# EasyEDA Pro project Arduino UNO DIY.eprj, board PCB3B
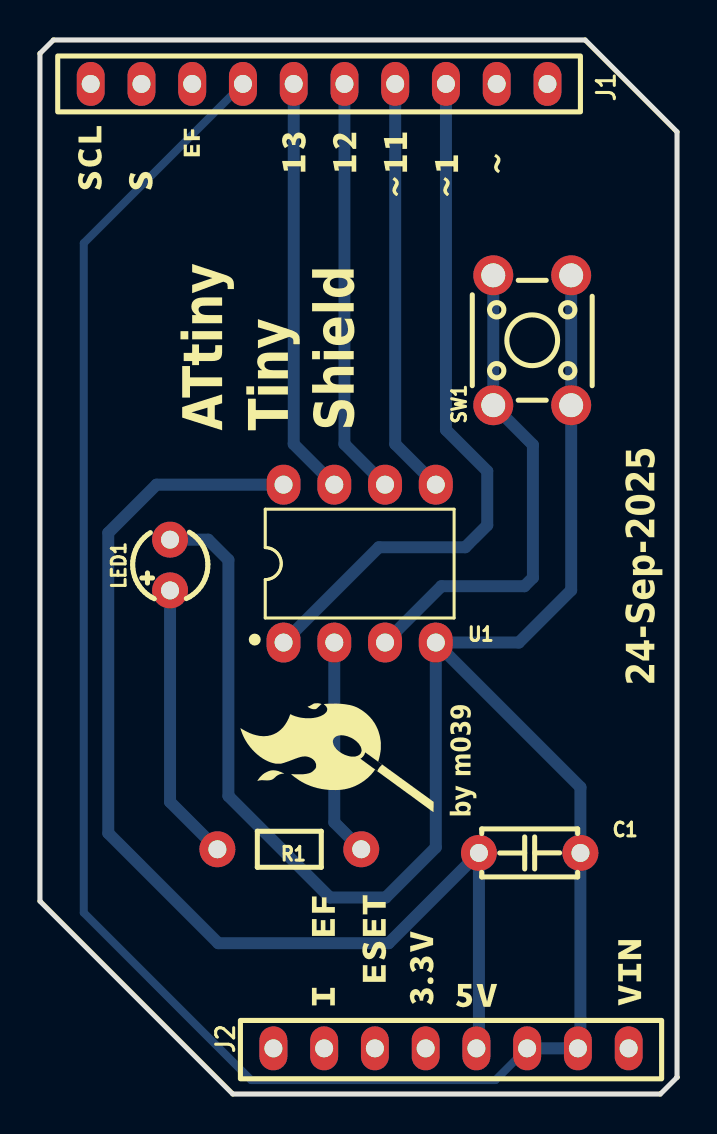
[diagram p14: board, top side]
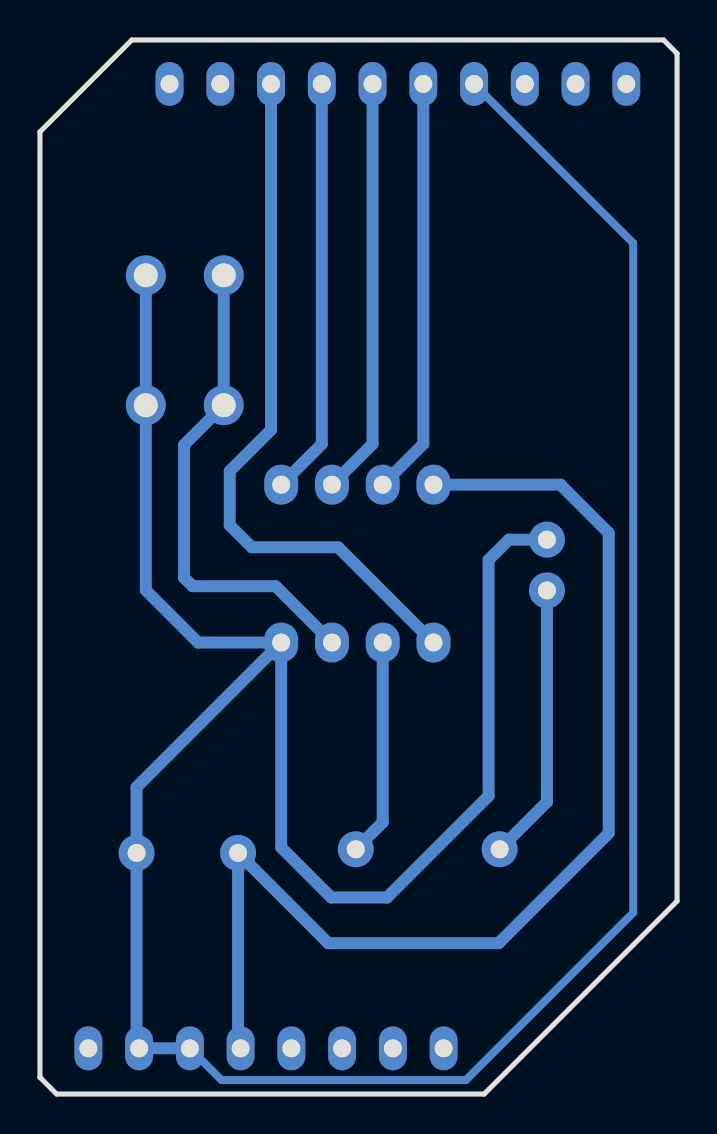
[diagram p15: board, bottom side, seen from below]

Outline 31.89 x 52.75 mm; copper layers: Top Layer, Bottom Layer. Coordinates in mm from the lower left corner of the outline.
Outline path: 31.89,0.83 31.05,0 9.65,0 0,9.65 0,52.07 0.68,52.75 27.29,52.75 31.89,48.15 31.89,0.83 ; 31.89,0.83 31.89,0.84
Stack: Top Layer 0.035mm / Dielectric1 1.51mm FR4 er 4.5 / Bottom Layer 0.035mm

## Design rules (mm)
template: Custom Config
spacing copperThickness1oz (default): track to track 0.27, other pairs 0.152 to 0.4
spacing copperThickness2oz: track to track 0.203, other pairs 0.152 to 0.3
track width copperThickness1oz (default): min 0.127, default 0.6, max 2.54
track width copperThickness2oz: min 0.203, default 0.4, max 2.54
differential pair differentialPair (default): width min 0.127, default 0.254, max 2.54; gap min 0.152, default 0.152
via viaSize (default): diameter min 0.5, default 0.61, max 10; hole min 0.3, default 0.305, max 6.3

## Placement (name value [footprint] x y rotation side)
C1  100nF  [CAP-TH_L4.8-W2.4-P5.08-D0.6]  24.51 12.06 0 top
J1  -  [Arduino Uno Top Header]  25.4 50.55 0 top
J2  -  [Arduino Uno Bottom Header]  29.59 2.16 0 top
LED1  -  [LED-TH_BD3.0-P2.54-FD]  6.51 26.47 90 top
R1  200Ω  [RES-TH_BD1.8-L3.2-P7.20-D0.4]  12.48 12.25 180 top
SW1  -  [KEY-TH_4P-L6.0-W6.0-P3.90-LS6.5]  24.64 37.72 90 top
U1  ATTINY85-20PU  [PDIP-8_L9.3-W6.4-P2.54-LS7.9-BL-1]  16 26.54 0 top

## Footprints (pads in the part's own frame, mm; a bottom-side part is the same pattern mirrored in y, then rotated)
Arduino Uno Bottom Header
  oval 1.4x2.2 hole 0.9: 1(-17.907,0.127) 2(-15.367,0.127) 3(-12.827,0.127) 4(-10.287,0.127) 5(-7.747,0.127) 6(-5.207,0.127) 7(-2.667,0.127) 8(-0.127,0.127)
Arduino Uno Top Header
  oval 1.4x2.2 hole 0.9: 9(0,0) 10(-2.54,0) 11(-5.08,0) 12(-7.62,0) 13(-10.16,0) 14(-12.7,0) 15(-15.24,0) 16(-17.78,0) 17(-20.32,0) 18(-22.86,0)
CAP-TH_L4.8-W2.4-P5.08-D0.6
  round 1.8 hole 0.9: 1(-2.54,0) 2(2.54,0)
KEY-TH_4P-L6.0-W6.0-P3.90-LS6.5
  round 2 hole 1.2x0.9: 1(-3.25,1.95) 2(3.25,1.95) 3(-3.25,-1.95) 4(3.25,-1.95)
LED-TH_BD3.0-P2.54-FD
  round 1.8 hole 0.9: 1(-1.27,0) 2(1.27,0)
PDIP-8_L9.3-W6.4-P2.54-LS7.9-BL-1
  oval 1.7x2 hole 0.9: 1(-3.81,-3.95) 2(-1.27,-3.95) 3(1.27,-3.95) 4(3.81,-3.95) 5(3.81,3.95) 6(1.27,3.95) 7(-1.27,3.95) 8(-3.81,3.95)
RES-TH_BD1.8-L3.2-P7.20-D0.4
  round 1.8 hole 0.9: 1(-3.6,0) 2(3.6,0)

## Nets
As in the schematic.

Pads without a net: J1 9 10 16 17 18; J2 1 2 3 4 8

## Routing (per net, layer and track width the routed paths; a pad name or vN(x,y) marks a point on that pad's centre or on a via; arc(x,y) is an arc through that point)
GND: length 159.5
  Bottom Layer w0.4: J2.6 22.8,0.7 10.57,0.7 2.19,9.07 2.19,42.58 J1.15
  Bottom Layer w0.6: SW1.4 SW1.3 26.59,25.21 23.97,22.59 U1.4 ; U1.4 19.81,12.34 17.31,9.84 14.51,9.84 9.43,14.92 9.43,26.73 8.42,27.74 LED1.2 ; U1.4 27.05,15.35 C1.2 27.05,2.41 J2.7 J2.6
VCC: length 57.3
  Bottom Layer w0.6: U1.8 5.83,30.49 3.42,28.08 3.42,13.05 8.92,7.55 17.46,7.55 C1.1 21.97,2.41 J2.5
BUTTON: length 24.7
  Bottom Layer w0.6: U1.3 20.09,25.41 24.25,25.41 24.67,25.84 24.67,32.48 SW1.1 SW1.2
LED: length 10.9
  Bottom Layer w0.6: R1.1 14.73,13.6 U1.2
MISO: length 20.9
  Bottom Layer w0.6: J1.13 15.24,32.53 U1.6
MOSI: length 20.9
  Bottom Layer w0.6: U1.5 17.78,32.53 J1.12
RST: length 35.6
  Bottom Layer w0.6: U1.1 16.96,27.36 21.28,27.36 22.39,28.46 22.39,31.17 20.32,33.24 J1.11
SCK: length 20.9
  Bottom Layer w0.6: U1.7 12.7,32.53 J1.14
$1N517: length 13.9
  Bottom Layer w0.6: R1.2 6.51,14.62 6.51,25.2

## Text on the board
Top Silkscreen Layer: by m039 | 24-Sep-2025 | ATtiny / Tiny / Shield
